# Altium schematic sheet Array.SchDoc (part 1 of 3)
size 254 x 304 mm; SheetNumber: 3; SheetTotal: 3
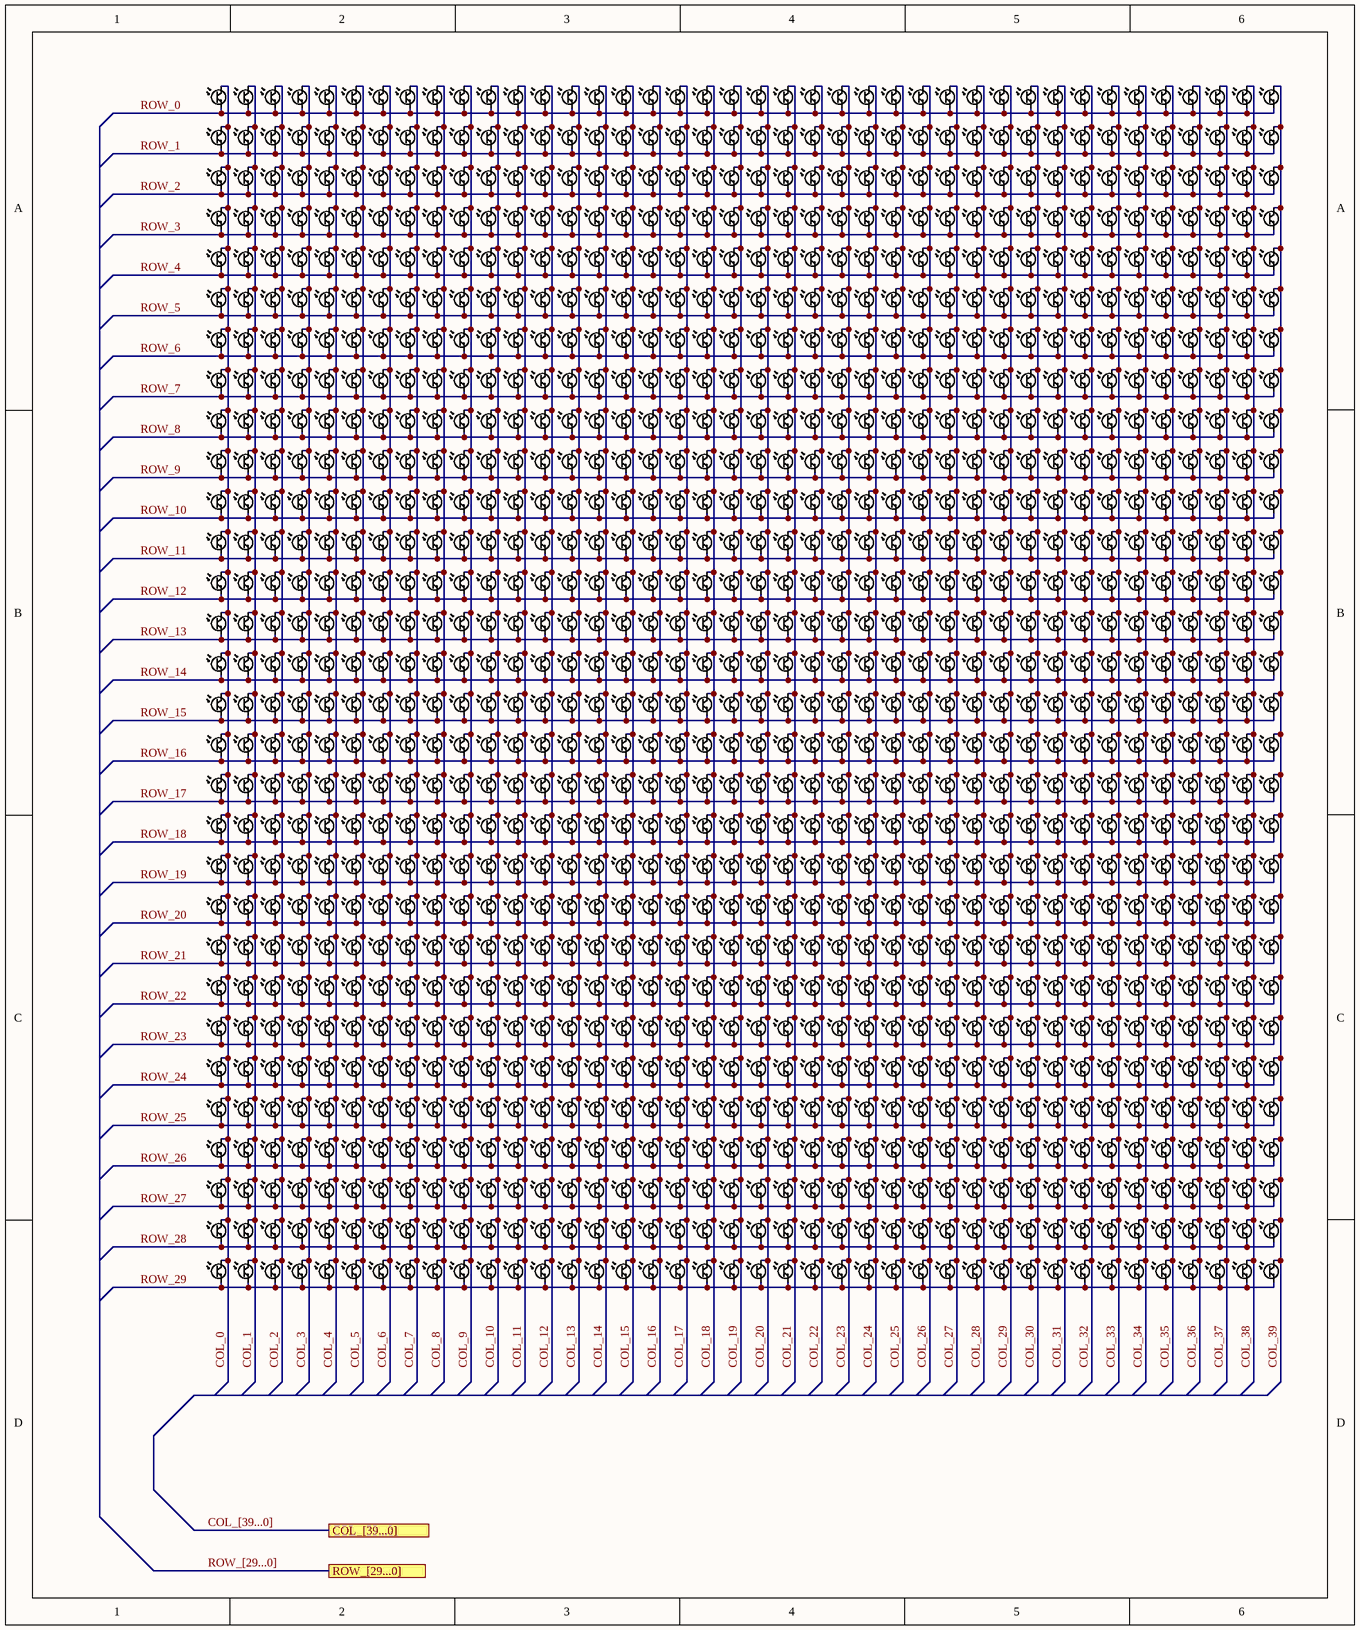
[diagram p0: Array.SchDoc]